# EAGLE board Resistor_Resistor (EAGLE 8.3.0), part 6 of 32
## Placement (x,y rotation side) (continued)
R6552  10K  [0201]  64.36,93.32 0 top
R6553  10K  [0201]  64.36,93.93 0 top
R6554  10K  [0201]  64.36,94.54 0 top
R6555  10K  [0201]  64.36,95.15 0 top
R6556  10K  [0201]  64.36,95.76 0 top
R6557  10K  [0201]  64.36,96.37 0 top
R6558  10K  [0201]  64.36,96.98 0 top
R6559  10K  [0201]  64.36,97.59 0 top
R6560  10K  [0201]  64.36,98.2 0 top
R6561  10K  [0201]  64.36,98.81 0 top
R6562  10K  [0201]  64.36,99.42 0 top
R6563  10K  [0201]  64.36,100.03 0 top
R6564  10K  [0201]  64.36,100.63 0 top
R6565  10K  [0201]  64.36,101.24 0 top
R6566  10K  [0201]  64.36,101.85 0 top
R6567  10K  [0201]  64.36,102.46 0 top
R6568  10K  [0201]  64.36,103.07 0 top
R6569  10K  [0201]  64.36,103.68 0 top
R6570  10K  [0201]  64.36,104.29 0 top
R6571  10K  [0201]  64.36,104.9 0 top
R6572  10K  [0201]  64.36,105.51 0 top
R6573  10K  [0201]  64.36,106.12 0 top
R6574  10K  [0201]  64.36,106.73 0 top
R6575  10K  [0201]  64.36,107.34 0 top
R6576  10K  [0201]  64.36,107.95 0 top
R6577  10K  [0201]  64.36,108.56 0 top
R6578  10K  [0201]  64.36,109.17 0 top
R6579  10K  [0201]  64.36,109.78 0 top
R6580  10K  [0201]  64.36,110.39 0 top
R6581  10K  [0201]  64.36,111 0 top
R6582  10K  [0201]  64.36,111.61 0 top
R6583  10K  [0201]  64.36,112.22 0 top
R6584  10K  [0201]  64.36,112.83 0 top
R6585  10K  [0201]  64.36,113.44 0 top
R6586  10K  [0201]  64.36,114.05 0 top
R6587  10K  [0201]  64.36,114.66 0 top
R6588  10K  [0201]  64.36,115.27 0 top
R6589  10K  [0201]  64.36,115.87 0 top
R6590  10K  [0201]  64.36,116.48 0 top
R6591  10K  [0201]  64.36,117.09 0 top
R6592  10K  [0201]  64.36,117.7 0 top
R6593  10K  [0201]  64.36,118.31 0 top
R6594  10K  [0201]  64.36,118.92 0 top
R6595  10K  [0201]  64.36,119.53 0 top
R6596  10K  [0201]  64.36,120.14 0 top
R6597  10K  [0201]  64.36,120.75 0 top
R6598  10K  [0201]  64.36,121.36 0 top
R6599  10K  [0201]  64.36,121.97 0 top
R6600  10K  [0201]  64.36,122.58 0 top
R6601  10K  [0201]  65.58,1.27 0 top
R6602  10K  [0201]  65.58,1.88 0 top
R6603  10K  [0201]  65.58,2.49 0 top
R6604  10K  [0201]  65.58,3.1 0 top
R6605  10K  [0201]  65.58,3.71 0 top
R6606  10K  [0201]  65.58,4.32 0 top
R6607  10K  [0201]  65.58,4.93 0 top
R6608  10K  [0201]  65.58,5.54 0 top
R6609  10K  [0201]  65.58,6.15 0 top
R6610  10K  [0201]  65.58,6.76 0 top
R6611  10K  [0201]  65.58,7.37 0 top
R6612  10K  [0201]  65.58,7.98 0 top
R6613  10K  [0201]  65.58,8.59 0 top
R6614  10K  [0201]  65.58,9.19 0 top
R6615  10K  [0201]  65.58,9.8 0 top
R6616  10K  [0201]  65.58,10.41 0 top
R6617  10K  [0201]  65.58,11.02 0 top
R6618  10K  [0201]  65.58,11.63 0 top
R6619  10K  [0201]  65.58,12.24 0 top
R6620  10K  [0201]  65.58,12.85 0 top
R6621  10K  [0201]  65.58,13.46 0 top
R6622  10K  [0201]  65.58,14.07 0 top
R6623  10K  [0201]  65.58,14.68 0 top
R6624  10K  [0201]  65.58,15.29 0 top
R6625  10K  [0201]  65.58,15.9 0 top
R6626  10K  [0201]  65.58,16.51 0 top
R6627  10K  [0201]  65.58,17.12 0 top
R6628  10K  [0201]  65.58,17.73 0 top
R6629  10K  [0201]  65.58,18.34 0 top
R6630  10K  [0201]  65.58,18.95 0 top
R6631  10K  [0201]  65.58,19.56 0 top
R6632  10K  [0201]  65.58,20.17 0 top
R6633  10K  [0201]  65.58,20.78 0 top
R6634  10K  [0201]  65.58,21.39 0 top
R6635  10K  [0201]  65.58,22 0 top
R6636  10K  [0201]  65.58,22.61 0 top
R6637  10K  [0201]  65.58,23.22 0 top
R6638  10K  [0201]  65.58,23.83 0 top
R6639  10K  [0201]  65.58,24.43 0 top
R6640  10K  [0201]  65.58,25.04 0 top
R6641  10K  [0201]  65.58,25.65 0 top
R6642  10K  [0201]  65.58,26.26 0 top
R6643  10K  [0201]  65.58,26.87 0 top
R6644  10K  [0201]  65.58,27.48 0 top
R6645  10K  [0201]  65.58,28.09 0 top
R6646  10K  [0201]  65.58,28.7 0 top
R6647  10K  [0201]  65.58,29.31 0 top
R6648  10K  [0201]  65.58,29.92 0 top
R6649  10K  [0201]  65.58,30.53 0 top
R6650  10K  [0201]  65.58,31.14 0 top
R6651  10K  [0201]  65.58,31.75 0 top
R6652  10K  [0201]  65.58,32.36 0 top
R6653  10K  [0201]  65.58,32.97 0 top
R6654  10K  [0201]  65.58,33.58 0 top
R6655  10K  [0201]  65.58,34.19 0 top
R6656  10K  [0201]  65.58,34.8 0 top
R6657  10K  [0201]  65.58,35.41 0 top
R6658  10K  [0201]  65.58,36.02 0 top
R6659  10K  [0201]  65.58,36.63 0 top
R6660  10K  [0201]  65.58,37.24 0 top
R6661  10K  [0201]  65.58,37.85 0 top
R6662  10K  [0201]  65.58,38.46 0 top
R6663  10K  [0201]  65.58,39.07 0 top
R6664  10K  [0201]  65.58,39.67 0 top
R6665  10K  [0201]  65.58,40.28 0 top
R6666  10K  [0201]  65.58,40.89 0 top
R6667  10K  [0201]  65.58,41.5 0 top
R6668  10K  [0201]  65.58,42.11 0 top
R6669  10K  [0201]  65.58,42.72 0 top
R6670  10K  [0201]  65.58,43.33 0 top
R6671  10K  [0201]  65.58,43.94 0 top
R6672  10K  [0201]  65.58,44.55 0 top
R6673  10K  [0201]  65.58,45.16 0 top
R6674  10K  [0201]  65.58,45.77 0 top
R6675  10K  [0201]  65.58,46.38 0 top
R6676  10K  [0201]  65.58,46.99 0 top
R6677  10K  [0201]  65.58,47.6 0 top
R6678  10K  [0201]  65.58,48.21 0 top
R6679  10K  [0201]  65.58,48.82 0 top
R6680  10K  [0201]  65.58,49.43 0 top
R6681  10K  [0201]  65.58,50.04 0 top
R6682  10K  [0201]  65.58,50.65 0 top
R6683  10K  [0201]  65.58,51.26 0 top
R6684  10K  [0201]  65.58,51.87 0 top
R6685  10K  [0201]  65.58,52.48 0 top
R6686  10K  [0201]  65.58,53.09 0 top
R6687  10K  [0201]  65.58,53.7 0 top
R6688  10K  [0201]  65.58,54.31 0 top
R6689  10K  [0201]  65.58,54.91 0 top
R6690  10K  [0201]  65.58,55.52 0 top
R6691  10K  [0201]  65.58,56.13 0 top
R6692  10K  [0201]  65.58,56.74 0 top
R6693  10K  [0201]  65.58,57.35 0 top
R6694  10K  [0201]  65.58,57.96 0 top
R6695  10K  [0201]  65.58,58.57 0 top
R6696  10K  [0201]  65.58,59.18 0 top
R6697  10K  [0201]  65.58,59.79 0 top
R6698  10K  [0201]  65.58,60.4 0 top
R6699  10K  [0201]  65.58,61.01 0 top
R6700  10K  [0201]  65.58,61.62 0 top
R6701  10K  [0201]  65.58,62.23 0 top
R6702  10K  [0201]  65.58,62.84 0 top
R6703  10K  [0201]  65.58,63.45 0 top
R6704  10K  [0201]  65.58,64.06 0 top
R6705  10K  [0201]  65.58,64.67 0 top
R6706  10K  [0201]  65.58,65.28 0 top
R6707  10K  [0201]  65.58,65.89 0 top
R6708  10K  [0201]  65.58,66.5 0 top
R6709  10K  [0201]  65.58,67.11 0 top
R6710  10K  [0201]  65.58,67.72 0 top
R6711  10K  [0201]  65.58,68.33 0 top
R6712  10K  [0201]  65.58,68.94 0 top
R6713  10K  [0201]  65.58,69.55 0 top
R6714  10K  [0201]  65.58,70.15 0 top
R6715  10K  [0201]  65.58,70.76 0 top
R6716  10K  [0201]  65.58,71.37 0 top
R6717  10K  [0201]  65.58,71.98 0 top
R6718  10K  [0201]  65.58,72.59 0 top
R6719  10K  [0201]  65.58,73.2 0 top
R6720  10K  [0201]  65.58,73.81 0 top
R6721  10K  [0201]  65.58,74.42 0 top
R6722  10K  [0201]  65.58,75.03 0 top
R6723  10K  [0201]  65.58,75.64 0 top
R6724  10K  [0201]  65.58,76.25 0 top
R6725  10K  [0201]  65.58,76.86 0 top
R6726  10K  [0201]  65.58,77.47 0 top
R6727  10K  [0201]  65.58,78.08 0 top
R6728  10K  [0201]  65.58,78.69 0 top
R6729  10K  [0201]  65.58,79.3 0 top
R6730  10K  [0201]  65.58,79.91 0 top
R6731  10K  [0201]  65.58,80.52 0 top
R6732  10K  [0201]  65.58,81.13 0 top
R6733  10K  [0201]  65.58,81.74 0 top
R6734  10K  [0201]  65.58,82.35 0 top
R6735  10K  [0201]  65.58,82.96 0 top
R6736  10K  [0201]  65.58,83.57 0 top
R6737  10K  [0201]  65.58,84.18 0 top
R6738  10K  [0201]  65.58,84.79 0 top
R6739  10K  [0201]  65.58,85.39 0 top
R6740  10K  [0201]  65.58,86 0 top
R6741  10K  [0201]  65.58,86.61 0 top
R6742  10K  [0201]  65.58,87.22 0 top
R6743  10K  [0201]  65.58,87.83 0 top
R6744  10K  [0201]  65.58,88.44 0 top
R6745  10K  [0201]  65.58,89.05 0 top
R6746  10K  [0201]  65.58,89.66 0 top
R6747  10K  [0201]  65.58,90.27 0 top
R6748  10K  [0201]  65.58,90.88 0 top
R6749  10K  [0201]  65.58,91.49 0 top
R6750  10K  [0201]  65.58,92.1 0 top
R6751  10K  [0201]  65.58,92.71 0 top
R6752  10K  [0201]  65.58,93.32 0 top
R6753  10K  [0201]  65.58,93.93 0 top
R6754  10K  [0201]  65.58,94.54 0 top
R6755  10K  [0201]  65.58,95.15 0 top
R6756  10K  [0201]  65.58,95.76 0 top
R6757  10K  [0201]  65.58,96.37 0 top
R6758  10K  [0201]  65.58,96.98 0 top
R6759  10K  [0201]  65.58,97.59 0 top
R6760  10K  [0201]  65.58,98.2 0 top
R6761  10K  [0201]  65.58,98.81 0 top
R6762  10K  [0201]  65.58,99.42 0 top
R6763  10K  [0201]  65.58,100.03 0 top
R6764  10K  [0201]  65.58,100.63 0 top
R6765  10K  [0201]  65.58,101.24 0 top
R6766  10K  [0201]  65.58,101.85 0 top
R6767  10K  [0201]  65.58,102.46 0 top
R6768  10K  [0201]  65.58,103.07 0 top
R6769  10K  [0201]  65.58,103.68 0 top
R6770  10K  [0201]  65.58,104.29 0 top
R6771  10K  [0201]  65.58,104.9 0 top
R6772  10K  [0201]  65.58,105.51 0 top
R6773  10K  [0201]  65.58,106.12 0 top
R6774  10K  [0201]  65.58,106.73 0 top
R6775  10K  [0201]  65.58,107.34 0 top
R6776  10K  [0201]  65.58,107.95 0 top
R6777  10K  [0201]  65.58,108.56 0 top
R6778  10K  [0201]  65.58,109.17 0 top
R6779  10K  [0201]  65.58,109.78 0 top
R6780  10K  [0201]  65.58,110.39 0 top
R6781  10K  [0201]  65.58,111 0 top
R6782  10K  [0201]  65.58,111.61 0 top
R6783  10K  [0201]  65.58,112.22 0 top
R6784  10K  [0201]  65.58,112.83 0 top
R6785  10K  [0201]  65.58,113.44 0 top
R6786  10K  [0201]  65.58,114.05 0 top
R6787  10K  [0201]  65.58,114.66 0 top
R6788  10K  [0201]  65.58,115.27 0 top
R6789  10K  [0201]  65.58,115.87 0 top
R6790  10K  [0201]  65.58,116.48 0 top
R6791  10K  [0201]  65.58,117.09 0 top
R6792  10K  [0201]  65.58,117.7 0 top
R6793  10K  [0201]  65.58,118.31 0 top
R6794  10K  [0201]  65.58,118.92 0 top
R6795  10K  [0201]  65.58,119.53 0 top
R6796  10K  [0201]  65.58,120.14 0 top
R6797  10K  [0201]  65.58,120.75 0 top
R6798  10K  [0201]  65.58,121.36 0 top
R6799  10K  [0201]  65.58,121.97 0 top
R6800  10K  [0201]  65.58,122.58 0 top
R6801  10K  [0201]  66.8,1.27 0 top
R6802  10K  [0201]  66.8,1.88 0 top
R6803  10K  [0201]  66.8,2.49 0 top
R6804  10K  [0201]  66.8,3.1 0 top
R6805  10K  [0201]  66.8,3.71 0 top
R6806  10K  [0201]  66.8,4.32 0 top
R6807  10K  [0201]  66.8,4.93 0 top
R6808  10K  [0201]  66.8,5.54 0 top
R6809  10K  [0201]  66.8,6.15 0 top
R6810  10K  [0201]  66.8,6.76 0 top
R6811  10K  [0201]  66.8,7.37 0 top
R6812  10K  [0201]  66.8,7.98 0 top
R6813  10K  [0201]  66.8,8.59 0 top
R6814  10K  [0201]  66.8,9.19 0 top
R6815  10K  [0201]  66.8,9.8 0 top
R6816  10K  [0201]  66.8,10.41 0 top
R6817  10K  [0201]  66.8,11.02 0 top
R6818  10K  [0201]  66.8,11.63 0 top
R6819  10K  [0201]  66.8,12.24 0 top
R6820  10K  [0201]  66.8,12.85 0 top
R6821  10K  [0201]  66.8,13.46 0 top
R6822  10K  [0201]  66.8,14.07 0 top
R6823  10K  [0201]  66.8,14.68 0 top
R6824  10K  [0201]  66.8,15.29 0 top
R6825  10K  [0201]  66.8,15.9 0 top
R6826  10K  [0201]  66.8,16.51 0 top
R6827  10K  [0201]  66.8,17.12 0 top
R6828  10K  [0201]  66.8,17.73 0 top
R6829  10K  [0201]  66.8,18.34 0 top
R6830  10K  [0201]  66.8,18.95 0 top
R6831  10K  [0201]  66.8,19.56 0 top
R6832  10K  [0201]  66.8,20.17 0 top
R6833  10K  [0201]  66.8,20.78 0 top
R6834  10K  [0201]  66.8,21.39 0 top
R6835  10K  [0201]  66.8,22 0 top
R6836  10K  [0201]  66.8,22.61 0 top
R6837  10K  [0201]  66.8,23.22 0 top
R6838  10K  [0201]  66.8,23.83 0 top
R6839  10K  [0201]  66.8,24.43 0 top
R6840  10K  [0201]  66.8,25.04 0 top
R6841  10K  [0201]  66.8,25.65 0 top
R6842  10K  [0201]  66.8,26.26 0 top
R6843  10K  [0201]  66.8,26.87 0 top
R6844  10K  [0201]  66.8,27.48 0 top
R6845  10K  [0201]  66.8,28.09 0 top
R6846  10K  [0201]  66.8,28.7 0 top
R6847  10K  [0201]  66.8,29.31 0 top
R6848  10K  [0201]  66.8,29.92 0 top
R6849  10K  [0201]  66.8,30.53 0 top
R6850  10K  [0201]  66.8,31.14 0 top
R6851  10K  [0201]  66.8,31.75 0 top
R6852  10K  [0201]  66.8,32.36 0 top
R6853  10K  [0201]  66.8,32.97 0 top
R6854  10K  [0201]  66.8,33.58 0 top
R6855  10K  [0201]  66.8,34.19 0 top
R6856  10K  [0201]  66.8,34.8 0 top
R6857  10K  [0201]  66.8,35.41 0 top
R6858  10K  [0201]  66.8,36.02 0 top
R6859  10K  [0201]  66.8,36.63 0 top
R6860  10K  [0201]  66.8,37.24 0 top
R6861  10K  [0201]  66.8,37.85 0 top
R6862  10K  [0201]  66.8,38.46 0 top
R6863  10K  [0201]  66.8,39.07 0 top
R6864  10K  [0201]  66.8,39.67 0 top
R6865  10K  [0201]  66.8,40.28 0 top
R6866  10K  [0201]  66.8,40.89 0 top
R6867  10K  [0201]  66.8,41.5 0 top
R6868  10K  [0201]  66.8,42.11 0 top
R6869  10K  [0201]  66.8,42.72 0 top
R6870  10K  [0201]  66.8,43.33 0 top
R6871  10K  [0201]  66.8,43.94 0 top
R6872  10K  [0201]  66.8,44.55 0 top
R6873  10K  [0201]  66.8,45.16 0 top
R6874  10K  [0201]  66.8,45.77 0 top
R6875  10K  [0201]  66.8,46.38 0 top
R6876  10K  [0201]  66.8,46.99 0 top
R6877  10K  [0201]  66.8,47.6 0 top
R6878  10K  [0201]  66.8,48.21 0 top
R6879  10K  [0201]  66.8,48.82 0 top
R6880  10K  [0201]  66.8,49.43 0 top
R6881  10K  [0201]  66.8,50.04 0 top
R6882  10K  [0201]  66.8,50.65 0 top
R6883  10K  [0201]  66.8,51.26 0 top
R6884  10K  [0201]  66.8,51.87 0 top
R6885  10K  [0201]  66.8,52.48 0 top
R6886  10K  [0201]  66.8,53.09 0 top
R6887  10K  [0201]  66.8,53.7 0 top
R6888  10K  [0201]  66.8,54.31 0 top
R6889  10K  [0201]  66.8,54.91 0 top
R6890  10K  [0201]  66.8,55.52 0 top
R6891  10K  [0201]  66.8,56.13 0 top
R6892  10K  [0201]  66.8,56.74 0 top
R6893  10K  [0201]  66.8,57.35 0 top
R6894  10K  [0201]  66.8,57.96 0 top
R6895  10K  [0201]  66.8,58.57 0 top
R6896  10K  [0201]  66.8,59.18 0 top
R6897  10K  [0201]  66.8,59.79 0 top
R6898  10K  [0201]  66.8,60.4 0 top
R6899  10K  [0201]  66.8,61.01 0 top
R6900  10K  [0201]  66.8,61.62 0 top
R6901  10K  [0201]  66.8,62.23 0 top
R6902  10K  [0201]  66.8,62.84 0 top
R6903  10K  [0201]  66.8,63.45 0 top
R6904  10K  [0201]  66.8,64.06 0 top
R6905  10K  [0201]  66.8,64.67 0 top
R6906  10K  [0201]  66.8,65.28 0 top
R6907  10K  [0201]  66.8,65.89 0 top
R6908  10K  [0201]  66.8,66.5 0 top
R6909  10K  [0201]  66.8,67.11 0 top
R6910  10K  [0201]  66.8,67.72 0 top
R6911  10K  [0201]  66.8,68.33 0 top
R6912  10K  [0201]  66.8,68.94 0 top
R6913  10K  [0201]  66.8,69.55 0 top
R6914  10K  [0201]  66.8,70.15 0 top
R6915  10K  [0201]  66.8,70.76 0 top
R6916  10K  [0201]  66.8,71.37 0 top
R6917  10K  [0201]  66.8,71.98 0 top
R6918  10K  [0201]  66.8,72.59 0 top
R6919  10K  [0201]  66.8,73.2 0 top
R6920  10K  [0201]  66.8,73.81 0 top
R6921  10K  [0201]  66.8,74.42 0 top
R6922  10K  [0201]  66.8,75.03 0 top
R6923  10K  [0201]  66.8,75.64 0 top
R6924  10K  [0201]  66.8,76.25 0 top
R6925  10K  [0201]  66.8,76.86 0 top
R6926  10K  [0201]  66.8,77.47 0 top
R6927  10K  [0201]  66.8,78.08 0 top
R6928  10K  [0201]  66.8,78.69 0 top
R6929  10K  [0201]  66.8,79.3 0 top
R6930  10K  [0201]  66.8,79.91 0 top
R6931  10K  [0201]  66.8,80.52 0 top
R6932  10K  [0201]  66.8,81.13 0 top
R6933  10K  [0201]  66.8,81.74 0 top
R6934  10K  [0201]  66.8,82.35 0 top
R6935  10K  [0201]  66.8,82.96 0 top
R6936  10K  [0201]  66.8,83.57 0 top
R6937  10K  [0201]  66.8,84.18 0 top
R6938  10K  [0201]  66.8,84.79 0 top
R6939  10K  [0201]  66.8,85.39 0 top
R6940  10K  [0201]  66.8,86 0 top
R6941  10K  [0201]  66.8,86.61 0 top
R6942  10K  [0201]  66.8,87.22 0 top
R6943  10K  [0201]  66.8,87.83 0 top
R6944  10K  [0201]  66.8,88.44 0 top
R6945  10K  [0201]  66.8,89.05 0 top
R6946  10K  [0201]  66.8,89.66 0 top
R6947  10K  [0201]  66.8,90.27 0 top
R6948  10K  [0201]  66.8,90.88 0 top
R6949  10K  [0201]  66.8,91.49 0 top
R6950  10K  [0201]  66.8,92.1 0 top
R6951  10K  [0201]  66.8,92.71 0 top
R6952  10K  [0201]  66.8,93.32 0 top
R6953  10K  [0201]  66.8,93.93 0 top
R6954  10K  [0201]  66.8,94.54 0 top
R6955  10K  [0201]  66.8,95.15 0 top
R6956  10K  [0201]  66.8,95.76 0 top
R6957  10K  [0201]  66.8,96.37 0 top
R6958  10K  [0201]  66.8,96.98 0 top
R6959  10K  [0201]  66.8,97.59 0 top
R6960  10K  [0201]  66.8,98.2 0 top
R6961  10K  [0201]  66.8,98.81 0 top
R6962  10K  [0201]  66.8,99.42 0 top
R6963  10K  [0201]  66.8,100.03 0 top
R6964  10K  [0201]  66.8,100.63 0 top
R6965  10K  [0201]  66.8,101.24 0 top
R6966  10K  [0201]  66.8,101.85 0 top
R6967  10K  [0201]  66.8,102.46 0 top
R6968  10K  [0201]  66.8,103.07 0 top
R6969  10K  [0201]  66.8,103.68 0 top
R6970  10K  [0201]  66.8,104.29 0 top
R6971  10K  [0201]  66.8,104.9 0 top
R6972  10K  [0201]  66.8,105.51 0 top
R6973  10K  [0201]  66.8,106.12 0 top
R6974  10K  [0201]  66.8,106.73 0 top
R6975  10K  [0201]  66.8,107.34 0 top
R6976  10K  [0201]  66.8,107.95 0 top
R6977  10K  [0201]  66.8,108.56 0 top
R6978  10K  [0201]  66.8,109.17 0 top
R6979  10K  [0201]  66.8,109.78 0 top
R6980  10K  [0201]  66.8,110.39 0 top
R6981  10K  [0201]  66.8,111 0 top
R6982  10K  [0201]  66.8,111.61 0 top
R6983  10K  [0201]  66.8,112.22 0 top
R6984  10K  [0201]  66.8,112.83 0 top
R6985  10K  [0201]  66.8,113.44 0 top
R6986  10K  [0201]  66.8,114.05 0 top
R6987  10K  [0201]  66.8,114.66 0 top
R6988  10K  [0201]  66.8,115.27 0 top
R6989  10K  [0201]  66.8,115.87 0 top
R6990  10K  [0201]  66.8,116.48 0 top
R6991  10K  [0201]  66.8,117.09 0 top
R6992  10K  [0201]  66.8,117.7 0 top
R6993  10K  [0201]  66.8,118.31 0 top
R6994  10K  [0201]  66.8,118.92 0 top
R6995  10K  [0201]  66.8,119.53 0 top
R6996  10K  [0201]  66.8,120.14 0 top
R6997  10K  [0201]  66.8,120.75 0 top
R6998  10K  [0201]  66.8,121.36 0 top
R6999  10K  [0201]  66.8,121.97 0 top
R7000  10K  [0201]  66.8,122.58 0 top
R7001  10K  [0201]  68.02,1.27 0 top
R7002  10K  [0201]  68.02,1.88 0 top
R7003  10K  [0201]  68.02,2.49 0 top
R7004  10K  [0201]  68.02,3.1 0 top
R7005  10K  [0201]  68.02,3.71 0 top
R7006  10K  [0201]  68.02,4.32 0 top
R7007  10K  [0201]  68.02,4.93 0 top
R7008  10K  [0201]  68.02,5.54 0 top
R7009  10K  [0201]  68.02,6.15 0 top
R7010  10K  [0201]  68.02,6.76 0 top
R7011  10K  [0201]  68.02,7.37 0 top
R7012  10K  [0201]  68.02,7.98 0 top
R7013  10K  [0201]  68.02,8.59 0 top
R7014  10K  [0201]  68.02,9.19 0 top
R7015  10K  [0201]  68.02,9.8 0 top
R7016  10K  [0201]  68.02,10.41 0 top
R7017  10K  [0201]  68.02,11.02 0 top
R7018  10K  [0201]  68.02,11.63 0 top
R7019  10K  [0201]  68.02,12.24 0 top
R7020  10K  [0201]  68.02,12.85 0 top
R7021  10K  [0201]  68.02,13.46 0 top
R7022  10K  [0201]  68.02,14.07 0 top
R7023  10K  [0201]  68.02,14.68 0 top
R7024  10K  [0201]  68.02,15.29 0 top
R7025  10K  [0201]  68.02,15.9 0 top
R7026  10K  [0201]  68.02,16.51 0 top
R7027  10K  [0201]  68.02,17.12 0 top
R7028  10K  [0201]  68.02,17.73 0 top
R7029  10K  [0201]  68.02,18.34 0 top
R7030  10K  [0201]  68.02,18.95 0 top
R7031  10K  [0201]  68.02,19.56 0 top
R7032  10K  [0201]  68.02,20.17 0 top
R7033  10K  [0201]  68.02,20.78 0 top
R7034  10K  [0201]  68.02,21.39 0 top
R7035  10K  [0201]  68.02,22 0 top
R7036  10K  [0201]  68.02,22.61 0 top
R7037  10K  [0201]  68.02,23.22 0 top
R7038  10K  [0201]  68.02,23.83 0 top
R7039  10K  [0201]  68.02,24.43 0 top
R7040  10K  [0201]  68.02,25.04 0 top
R7041  10K  [0201]  68.02,25.65 0 top
R7042  10K  [0201]  68.02,26.26 0 top
R7043  10K  [0201]  68.02,26.87 0 top
R7044  10K  [0201]  68.02,27.48 0 top
R7045  10K  [0201]  68.02,28.09 0 top
R7046  10K  [0201]  68.02,28.7 0 top
R7047  10K  [0201]  68.02,29.31 0 top
R7048  10K  [0201]  68.02,29.92 0 top
R7049  10K  [0201]  68.02,30.53 0 top
R7050  10K  [0201]  68.02,31.14 0 top
R7051  10K  [0201]  68.02,31.75 0 top
R7052  10K  [0201]  68.02,32.36 0 top
R7053  10K  [0201]  68.02,32.97 0 top
R7054  10K  [0201]  68.02,33.58 0 top
R7055  10K  [0201]  68.02,34.19 0 top
R7056  10K  [0201]  68.02,34.8 0 top
R7057  10K  [0201]  68.02,35.41 0 top
R7058  10K  [0201]  68.02,36.02 0 top
R7059  10K  [0201]  68.02,36.63 0 top
R7060  10K  [0201]  68.02,37.24 0 top
R7061  10K  [0201]  68.02,37.85 0 top
R7062  10K  [0201]  68.02,38.46 0 top
R7063  10K  [0201]  68.02,39.07 0 top
R7064  10K  [0201]  68.02,39.67 0 top
R7065  10K  [0201]  68.02,40.28 0 top
R7066  10K  [0201]  68.02,40.89 0 top
R7067  10K  [0201]  68.02,41.5 0 top
R7068  10K  [0201]  68.02,42.11 0 top
R7069  10K  [0201]  68.02,42.72 0 top
R7070  10K  [0201]  68.02,43.33 0 top
R7071  10K  [0201]  68.02,43.94 0 top
R7072  10K  [0201]  68.02,44.55 0 top
R7073  10K  [0201]  68.02,45.16 0 top
R7074  10K  [0201]  68.02,45.77 0 top
R7075  10K  [0201]  68.02,46.38 0 top
R7076  10K  [0201]  68.02,46.99 0 top
R7077  10K  [0201]  68.02,47.6 0 top
R7078  10K  [0201]  68.02,48.21 0 top
R7079  10K  [0201]  68.02,48.82 0 top
R7080  10K  [0201]  68.02,49.43 0 top
R7081  10K  [0201]  68.02,50.04 0 top
R7082  10K  [0201]  68.02,50.65 0 top
R7083  10K  [0201]  68.02,51.26 0 top
R7084  10K  [0201]  68.02,51.87 0 top
R7085  10K  [0201]  68.02,52.48 0 top
R7086  10K  [0201]  68.02,53.09 0 top
R7087  10K  [0201]  68.02,53.7 0 top
R7088  10K  [0201]  68.02,54.31 0 top
R7089  10K  [0201]  68.02,54.91 0 top
R7090  10K  [0201]  68.02,55.52 0 top
R7091  10K  [0201]  68.02,56.13 0 top
R7092  10K  [0201]  68.02,56.74 0 top
R7093  10K  [0201]  68.02,57.35 0 top
R7094  10K  [0201]  68.02,57.96 0 top
R7095  10K  [0201]  68.02,58.57 0 top
R7096  10K  [0201]  68.02,59.18 0 top
R7097  10K  [0201]  68.02,59.79 0 top
R7098  10K  [0201]  68.02,60.4 0 top
R7099  10K  [0201]  68.02,61.01 0 top
R7100  10K  [0201]  68.02,61.62 0 top
R7101  10K  [0201]  68.02,62.23 0 top
R7102  10K  [0201]  68.02,62.84 0 top
R7103  10K  [0201]  68.02,63.45 0 top
R7104  10K  [0201]  68.02,64.06 0 top
R7105  10K  [0201]  68.02,64.67 0 top
R7106  10K  [0201]  68.02,65.28 0 top
R7107  10K  [0201]  68.02,65.89 0 top
R7108  10K  [0201]  68.02,66.5 0 top
R7109  10K  [0201]  68.02,67.11 0 top
R7110  10K  [0201]  68.02,67.72 0 top
R7111  10K  [0201]  68.02,68.33 0 top
R7112  10K  [0201]  68.02,68.94 0 top
R7113  10K  [0201]  68.02,69.55 0 top
R7114  10K  [0201]  68.02,70.15 0 top
R7115  10K  [0201]  68.02,70.76 0 top
R7116  10K  [0201]  68.02,71.37 0 top
R7117  10K  [0201]  68.02,71.98 0 top
R7118  10K  [0201]  68.02,72.59 0 top
R7119  10K  [0201]  68.02,73.2 0 top
R7120  10K  [0201]  68.02,73.81 0 top
R7121  10K  [0201]  68.02,74.42 0 top
R7122  10K  [0201]  68.02,75.03 0 top
R7123  10K  [0201]  68.02,75.64 0 top
R7124  10K  [0201]  68.02,76.25 0 top
R7125  10K  [0201]  68.02,76.86 0 top
R7126  10K  [0201]  68.02,77.47 0 top
R7127  10K  [0201]  68.02,78.08 0 top
R7128  10K  [0201]  68.02,78.69 0 top
R7129  10K  [0201]  68.02,79.3 0 top
R7130  10K  [0201]  68.02,79.91 0 top
R7131  10K  [0201]  68.02,80.52 0 top
R7132  10K  [0201]  68.02,81.13 0 top
R7133  10K  [0201]  68.02,81.74 0 top
R7134  10K  [0201]  68.02,82.35 0 top
R7135  10K  [0201]  68.02,82.96 0 top
R7136  10K  [0201]  68.02,83.57 0 top
R7137  10K  [0201]  68.02,84.18 0 top
R7138  10K  [0201]  68.02,84.79 0 top
R7139  10K  [0201]  68.02,85.39 0 top
R7140  10K  [0201]  68.02,86 0 top
R7141  10K  [0201]  68.02,86.61 0 top
R7142  10K  [0201]  68.02,87.22 0 top
R7143  10K  [0201]  68.02,87.83 0 top
R7144  10K  [0201]  68.02,88.44 0 top
R7145  10K  [0201]  68.02,89.05 0 top
R7146  10K  [0201]  68.02,89.66 0 top
R7147  10K  [0201]  68.02,90.27 0 top
R7148  10K  [0201]  68.02,90.88 0 top
R7149  10K  [0201]  68.02,91.49 0 top
R7150  10K  [0201]  68.02,92.1 0 top
R7151  10K  [0201]  68.02,92.71 0 top
R7152  10K  [0201]  68.02,93.32 0 top
R7153  10K  [0201]  68.02,93.93 0 top
R7154  10K  [0201]  68.02,94.54 0 top
R7155  10K  [0201]  68.02,95.15 0 top
R7156  10K  [0201]  68.02,95.76 0 top
R7157  10K  [0201]  68.02,96.37 0 top
R7158  10K  [0201]  68.02,96.98 0 top
R7159  10K  [0201]  68.02,97.59 0 top
R7160  10K  [0201]  68.02,98.2 0 top
R7161  10K  [0201]  68.02,98.81 0 top
R7162  10K  [0201]  68.02,99.42 0 top
R7163  10K  [0201]  68.02,100.03 0 top
R7164  10K  [0201]  68.02,100.63 0 top
R7165  10K  [0201]  68.02,101.24 0 top
R7166  10K  [0201]  68.02,101.85 0 top
R7167  10K  [0201]  68.02,102.46 0 top
R7168  10K  [0201]  68.02,103.07 0 top
R7169  10K  [0201]  68.02,103.68 0 top
R7170  10K  [0201]  68.02,104.29 0 top
R7171  10K  [0201]  68.02,104.9 0 top
R7172  10K  [0201]  68.02,105.51 0 top
R7173  10K  [0201]  68.02,106.12 0 top
R7174  10K  [0201]  68.02,106.73 0 top
R7175  10K  [0201]  68.02,107.34 0 top
R7176  10K  [0201]  68.02,107.95 0 top
R7177  10K  [0201]  68.02,108.56 0 top
R7178  10K  [0201]  68.02,109.17 0 top
R7179  10K  [0201]  68.02,109.78 0 top
R7180  10K  [0201]  68.02,110.39 0 top
R7181  10K  [0201]  68.02,111 0 top
R7182  10K  [0201]  68.02,111.61 0 top
R7183  10K  [0201]  68.02,112.22 0 top
R7184  10K  [0201]  68.02,112.83 0 top
R7185  10K  [0201]  68.02,113.44 0 top
R7186  10K  [0201]  68.02,114.05 0 top
R7187  10K  [0201]  68.02,114.66 0 top
R7188  10K  [0201]  68.02,115.27 0 top
R7189  10K  [0201]  68.02,115.87 0 top
R7190  10K  [0201]  68.02,116.48 0 top
R7191  10K  [0201]  68.02,117.09 0 top
R7192  10K  [0201]  68.02,117.7 0 top
R7193  10K  [0201]  68.02,118.31 0 top
R7194  10K  [0201]  68.02,118.92 0 top
R7195  10K  [0201]  68.02,119.53 0 top
R7196  10K  [0201]  68.02,120.14 0 top
R7197  10K  [0201]  68.02,120.75 0 top
R7198  10K  [0201]  68.02,121.36 0 top
R7199  10K  [0201]  68.02,121.97 0 top
R7200  10K  [0201]  68.02,122.58 0 top
R7201  10K  [0201]  69.24,1.27 0 top
R7202  10K  [0201]  69.24,1.88 0 top
R7203  10K  [0201]  69.24,2.49 0 top
R7204  10K  [0201]  69.24,3.1 0 top
R7205  10K  [0201]  69.24,3.71 0 top
R7206  10K  [0201]  69.24,4.32 0 top
R7207  10K  [0201]  69.24,4.93 0 top
R7208  10K  [0201]  69.24,5.54 0 top
R7209  10K  [0201]  69.24,6.15 0 top